# EasyEDA Pro project Q's HelloWorld KeyBoard.eprj, schematic SCH 主体扩展接口板
Create Date: 2022-10-16; Page Name: P1; Project Name: Q's HelloWorld KeyBoard; Schematic Name: SCH 主体扩展接口板; Update Date: 2022-10-16; Company: 嘉立创EDA; Page Size: A5; Version: V1.0
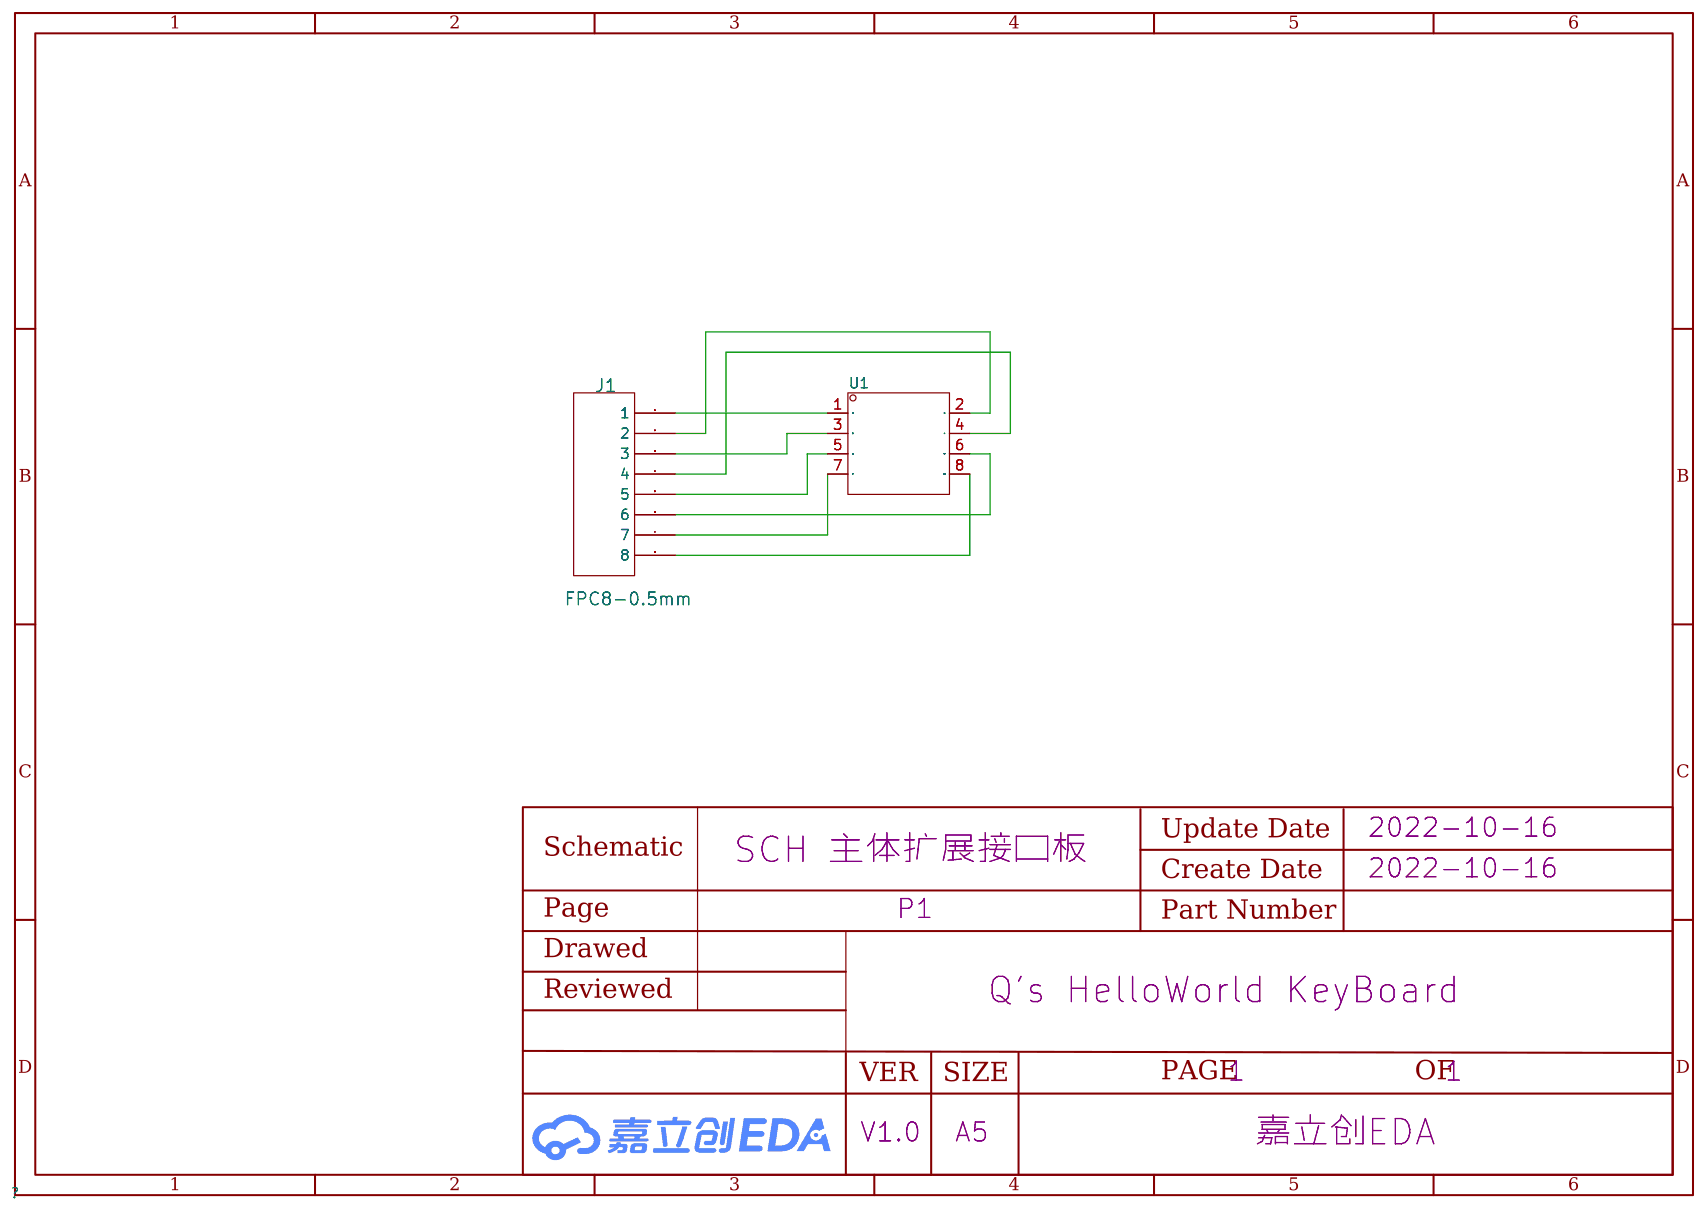
[diagram p0: schematic sheet]

## Parts
J1  FPC8-0.5mm  [FPC0.5-8P-STAND]
U1  MTP125-1204S1  [HDR-TH_8P-P2.54-V-M-R2-C4-S2.54]

## Library data of the parts
J1 = FPC8-0.5mm: LatestRevisionDate: 17-Jul-2002; LatestRevisionNote: Re-released for DXP Platform.; Publisher: Altium Limited
U1 = MTP125-1204S1: 间距:2.54mm;总PIN位数:8;排数:2;插针结构:2x4P;行距:2.54mm;安装类型:直插;圆针/方针:方针;额定电流:-;额定电压:-;配合针长度:6mm;塑高:2.5mm;端接针长度:3mm;触头材质:黄铜;触头镀层:-;工作温度范围:-40~+105;颜色:黑色;; LCSC Part Name: 2.54mm 2x4P 直插 方针; Supplier Part: C358693; Manufacturer: MINTRON(明硕); Supplier Footprint: 直插,P=2.54mm; JLCPCB Part Class: Extended Part; Datasheet: https://atta.szlcsc.com/upload/public/pdf/source/20190124/C358693_BDA2727DDB90EFE2D417117FFE47FBE2.pdf; Supplier: LCSC; Pitch: 2.54mm; Number of Pins: 8; Number of Rows: 2; Pin Structure: 2x4P; Row Spacing: 2.54mm; Mounting Type: 直插; Circluar Pins/Square Pins: 方针; Length of Mating Pin: 6mm; Insulation Height: 2.5mm; Length of End Connection Pin: 3mm; Contact Material: 黄铜; Operating Temperature Range: -40~+105; Color: 黑色

## Nets
$1N371: J1.1 U1.1
$1N374: J1.2 U1.2
$1N381: J1.3 U1.3
$1N386: J1.4 U1.4
$1N393: J1.5 U1.5
$1N398: J1.6 U1.6
$1N403: J1.7 U1.7
$1N407: J1.8 U1.8
